# EasyEDA Pro project Q's HelloWorld KeyBoard.eprj, schematic SCH 旋钮键盘板
Create Date: 2022-10-16; Page Name: P1; Project Name: Q's HelloWorld KeyBoard; Schematic Name: SCH 旋钮键盘板; Update Date: 2022-10-16; Company: 嘉立创EDA; Page Size: A4; Version: V1.0
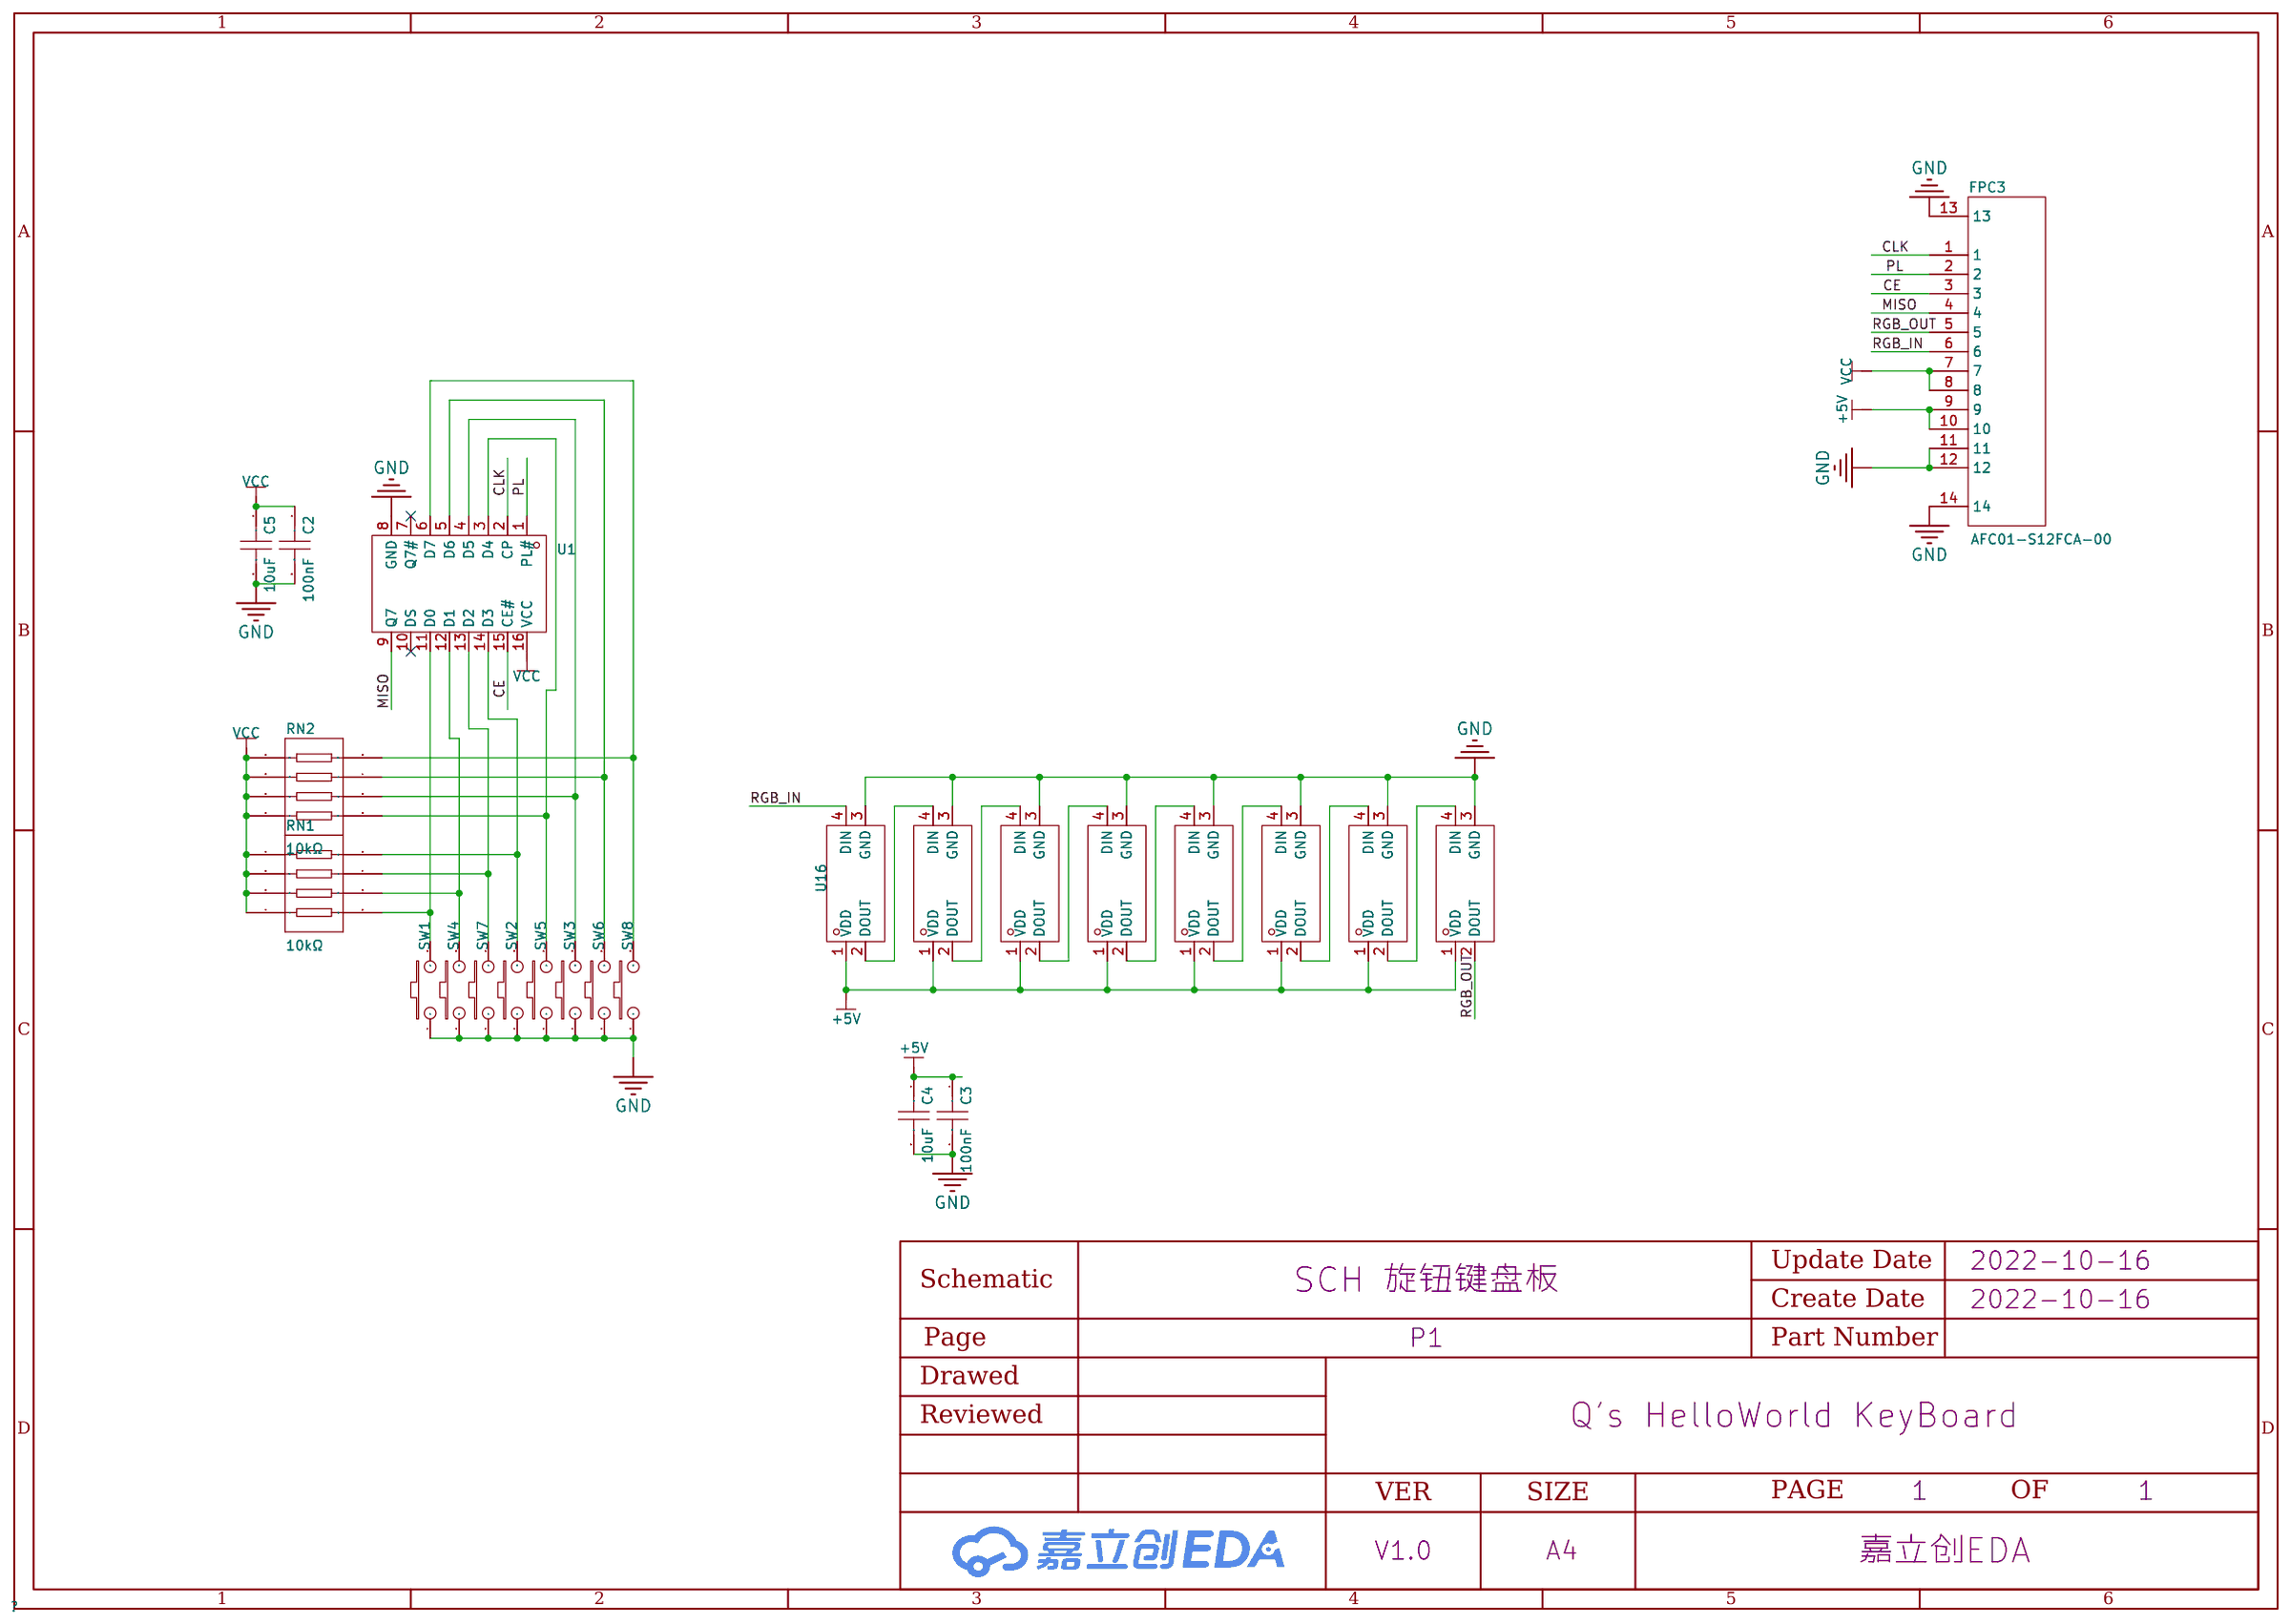
[diagram p7: schematic sheet]

## Parts
C2  100nF  [C0402]
C3  100nF  [C0402]
C4  10uF  [C0603]
C5  10uF  [C0603]
FPC3  AFC01-S12FCA-00  [FPC-SMD_AFC01-S12FCA-00]
RN1  10kΩ  [RES-ARRAY-SMD_0402-8P-L2.0-W1.0-BL]
RN2  10kΩ  [RES-ARRAY-SMD_0402-8P-L2.0-W1.0-BL]
SW1  -  [轴座_焊接热插拔_不带灯]
SW2  -  [轴座_焊接热插拔_不带灯]
SW3  -  [轴座_焊接热插拔_不带灯]
SW4  -  [轴座_焊接热插拔_不带灯]
SW5  -  [轴座_焊接热插拔_不带灯]
SW6  -  [轴座_焊接热插拔_不带灯]
SW7  -  [轴座_焊接热插拔_不带灯]
SW8  -  [轴座_焊接热插拔_不带灯]
U1  74HC165D,653  [SOIC-16_L9.9-W3.9-P1.27-LS6.0-BL]
U2  Yo-WS2812B-3528反贴雾状  [LED-SMD_L3.2-W2.8-BR_DY-S352818]
U3  Yo-WS2812B-3528反贴雾状  [LED-SMD_L3.2-W2.8-BR_DY-S352818]
U4  Yo-WS2812B-3528反贴雾状  [LED-SMD_L3.2-W2.8-BR_DY-S352818]
U5  Yo-WS2812B-3528反贴雾状  [LED-SMD_L3.2-W2.8-BR_DY-S352818]
U6  Yo-WS2812B-3528反贴雾状  [LED-SMD_L3.2-W2.8-BR_DY-S352818]
U7  Yo-WS2812B-3528反贴雾状  [LED-SMD_L3.2-W2.8-BR_DY-S352818]
U8  Yo-WS2812B-3528反贴雾状  [LED-SMD_L3.2-W2.8-BR_DY-S352818]
U16  Yo-WS2812B-3528反贴雾状  [LED-SMD_L3.2-W2.8-BR_DY-S352818]

## Library data of the parts
C2 C3 = GCM155R71C104KA55J: 容值:100nF;精度:±10%;额定电压:-;材质(温度系数):-;; LCSC Part Name: 100nF ±10%; Supplier Part: C2655418; Manufacturer: muRata(村田); Supplier Footprint: 0402; JLCPCB Part Class: Extended Part; Datasheet: https://atta.szlcsc.com/upload/public/pdf/source/20210701/42090801FDE37D0E45AFF657247F4A08.pdf; Supplier: LCSC; Tolerance: ±10%
C4 C5 = GRM188C81A106KA73D: 容值:10uF;精度:±10%;额定电压:-;材质(温度系数):-;; LCSC Part Name: 10uF ±10%; Supplier Part: C385036; Manufacturer: muRata(村田); Supplier Footprint: 0603; JLCPCB Part Class: Extended Part; Datasheet: https://atta.szlcsc.com/upload/public/pdf/source/20191220/C385036_14D8A38EE4E7ED3C8308778725CCABFB.pdf; Supplier: LCSC; Tolerance: ±10%
FPC3 = AFC01-S12FCA-00: 间距:0.5mm;触点数量:12;锁定特性:翻盖式;安装类型:卧贴;触点类型:下接;; LCSC Part Name: 0.5mm P数:12 翻盖式 下接; Supplier Part: C262661; Manufacturer: JS(钜硕电子); Supplier Footprint: SMD,P=0.5mm; JLCPCB Part Class: Extended Part; Datasheet: https://atta.szlcsc.com/upload/public/pdf/source/20180810/C262661_216573474FA4FCB7E7D6D6C5859A7896.pdf; Supplier: LCSC; Pitch: 0.5mm; Number of Contacts: 12; Locking Feature: 翻盖式; Mounting Type: 卧贴; Contact Type: 下接; Height Above Board: 2mm; FFC, FCB Thickness: 0.3mm
RN1 RN2 = 4D02WGJ0103TCE: 阻值:10kΩ;精度:±5%;单个元件功率:62.5mW;温度系数:±200ppm/;电阻器数:4;引脚数:8;; LCSC Part Name: 10kΩ ±5%; Supplier Part: C25725; Manufacturer: UNI-ROYAL(厚声); Supplier Footprint: 0402x4; JLCPCB Part Class: Basic Part; Datasheet: https://atta.szlcsc.com/upload/public/pdf/source/20170615/1497510998113.pdf; Supplier: LCSC; Tolerance: ±5%; Power(Watts): 62.5mW; Temperature Coefficient: ±200ppm/; Number of Resistors: 4; Number of Pins: 8
SW1-SW8 = KEYBOARD-SW: Origin Footprint 2: MX-KEY
U1 = 74HC165D,653: Supplier Part: C5613; Manufacturer: Nexperia(安世); Supplier Footprint: SOIC-16_150mil; JLCPCB Part Class: Basic Part; Datasheet: https://atta.szlcsc.com/upload/public/pdf/source/20160218/1457707760975.pdf; Supplier: LCSC
U2-U8 U16 = YO-WS2812B-3528反贴: Supplier: LCSC; Supplier Part: C9900003682; Manufacturer: null

## Nets
+5V: C3.1 C4.1 FPC3.9 FPC3.10 U2.1(VDD) U3.1(VDD) U4.1(VDD) U5.1(VDD) U6.1(VDD) U7.1(VDD) U8.1(VDD) U16.1(VDD)
GND: C2.2 C3.2 C4.2 C5.2 FPC3.11 FPC3.12 FPC3.13 FPC3.14 SW1.1 SW2.1 SW3.1 SW4.1 SW5.1 SW6.1 SW7.1 SW8.1 U1.8(GND) U2.3(GND) U3.3(GND) U4.3(GND) U5.3(GND) U6.3(GND) U7.3(GND) U8.3(GND) U16.3(GND)
VCC: C2.1 C5.1 FPC3.7 FPC3.8 RN1.1 RN1.2 RN1.3 RN1.4 RN2.1 RN2.2 RN2.3 RN2.4 U1.16(VCC)
CE: FPC3.3 U1.15(CE#)
CLK: FPC3.1 U1.2(CP)
MISO: FPC3.4 U1.9(Q7)
PL: FPC3.2 U1.1(PL#)
RGB_IN: FPC3.6 U16.4(DIN)
RGB_OUT: FPC3.5 U8.2(DOUT)
$1N1605: RN2.5 SW5.2 U1.3(D4)
$1N1712: RN2.8 SW8.2 U1.6(D7)
$1N11639: RN2.6 SW3.2 U1.4(D5)
$1N11734: RN2.7 SW6.2 U1.5(D6)
$1N12529: U4.4(DIN) U16.2(DOUT)
$1N12594: U4.2(DOUT) U7.4(DIN)
$1N12659: U2.4(DIN) U7.2(DOUT)
$1N12724: U2.2(DOUT) U5.4(DIN)
$1N12789: U3.4(DIN) U5.2(DOUT)
$1N12854: U3.2(DOUT) U6.4(DIN)
$1N12923: U6.2(DOUT) U8.4(DIN)
$1N14608: RN1.5 SW1.2 U1.11(D0)
$1N14697: RN1.6 SW4.2 U1.12(D1)
$1N14790: RN1.7 SW7.2 U1.13(D2)
$1N14885: RN1.8 SW2.2 U1.14(D3)

Not connected (* = marked no-connect by the designer): U1 7(Q7#)* 10(DS)*
